# EAGLE board BalanduinoPCB-V1.1 (EAGLE 6.2)
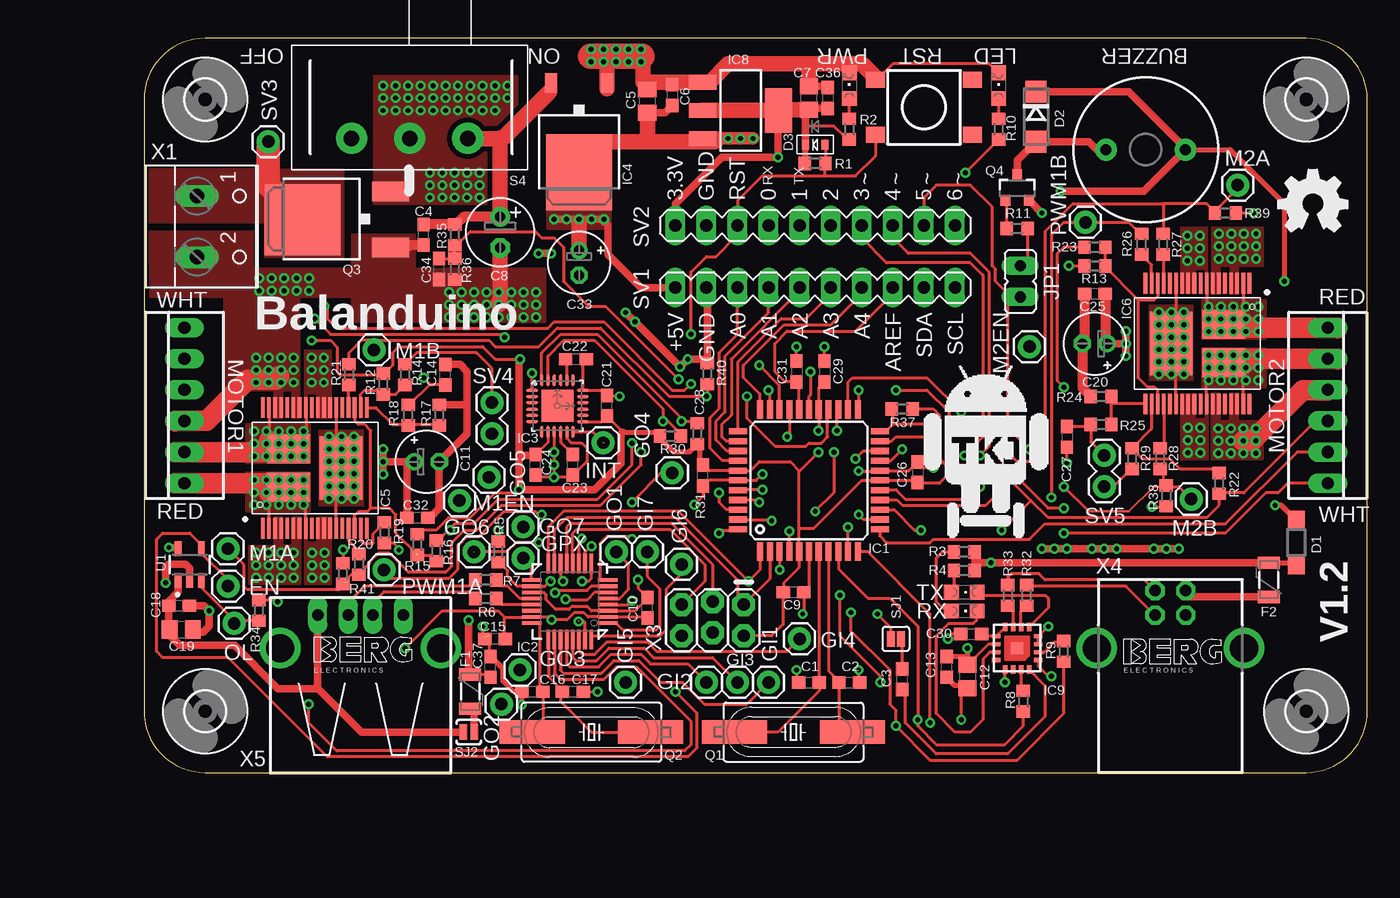
[diagram p2: board, top side]
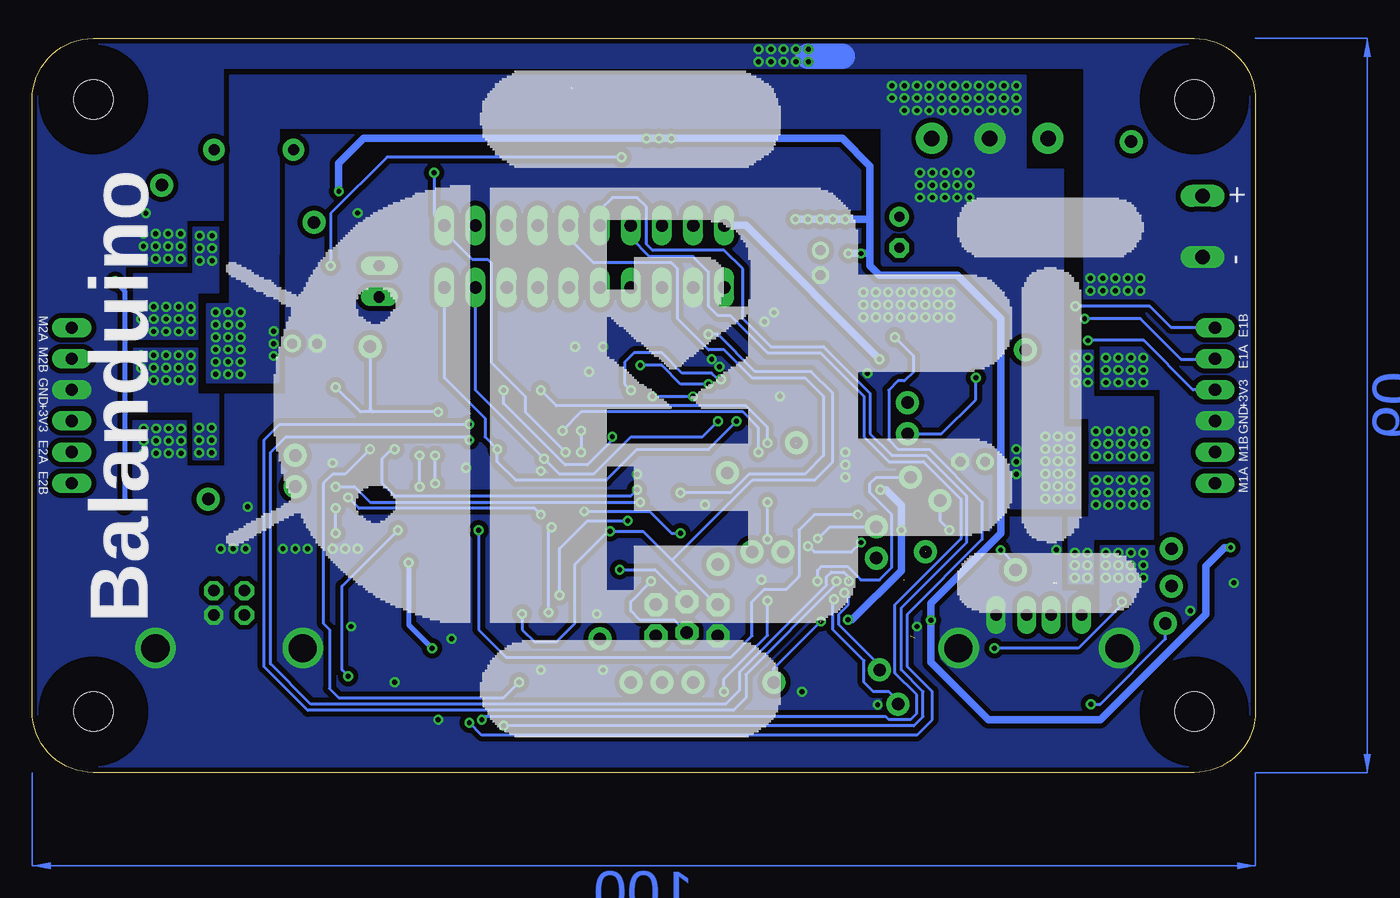
[diagram p3: board, bottom side, seen from below]

Size 100 x 60 mm. Coordinates in mm from the lower left corner, seen from the top.
Outline: 5,0 95,0 arc90 100,5 100,55 arc90 95,60 5,60 arc90 0,55 0,5 arc90 5,0
Copper layers (1*16): Top 0.035mm / dielectric 1.5mm / Bottom 0.035mm
Design rules "default": minimum track width 8mil, minimum drill 12mil, track to track 8mil, track to pad 8mil, pad to pad 7mil, via to via 8mil, smd to smd 0mil, copper to edge 8mil, drill to drill 8mil, minimum pad ring 12mil, minimum via ring 8mil, stop-mask expansion 4mil, vias tented up to drill 25mil, thermal gap 10mil

## Footprints (pad centres in the part's own frame; a part is rotated, then mirrored left to right if it is on the bottom)
BUZZER-12MM = drill 0.9 pad 1.778: + 3.25,0; - -3.25,0
C0603 = smd 1.1 x 1: 1 -0.85,0; 2 0.85,0
C0805 = smd 1.3 x 1.5: 1 -0.95,0; 2 0.95,0
E2,5-6 = drill 0.813 pad 1.6: + -1.27,0 | drill 0.813 pad 1.6 octagon: - 1.27,0
E2-5 = drill 0.813 pad 1.27: + -1.016,0 | drill 0.813 pad 1.27 octagon: - 1.016,0
SOD123 = smd 1.4 x 1.4: A 1.9,0; C -1.9,0
DO214AC = smd 1.8 x 1.7: A 2.05,0; C -2.05,0
SOD-523 = smd 0.8 x 0.6: A 0,-0.8; K 0,0.8
1X01 = drill 1.016 pad 1.88: 1 0,0
PTC-1206 = smd 1 x 1.8: 1 -1.4,0; 2 1.4,0
3,2 = hole 3.2: 0,0
TQFP44 = smd 1.5 x 0.5: 1 -5.8,4; 2 -5.8,3.2; 3 -5.8,2.4; 4 -5.8,1.6; 5 -5.8,0.8; 6 -5.8,0; 7 -5.8,-0.8; 8 -5.8,-1.6; 9 -5.8,-2.4; 10 -5.8,-3.2; 11 -5.8,-4; 23 5.8,-4; 24 5.8,-3.2; 25 5.8,-2.4; 26 5.8,-1.6; 27 5.8,-0.8; 28 5.8,0; 29 5.8,0.8; 30 5.8,1.6; 31 5.8,2.4; 32 5.8,3.2; 33 5.8,4 | smd 0.5 x 1.5: 12 -4,-5.8; 13 -3.2,-5.8; 14 -2.4,-5.8; 15 -1.6,-5.8; 16 -0.8,-5.8; 17 0,-5.8; 18 0.8,-5.8; 19 1.6,-5.8; 20 2.4,-5.8; 21 3.2,-5.8; 22 4,-5.8; 34 4,5.8; 35 3.2,5.8; 36 2.4,5.8; 37 1.6,5.8; 38 0.8,5.8; 39 0,5.8; 40 -0.8,5.8; 41 -1.6,5.8; 42 -2.4,5.8; 43 -3.2,5.8; 44 -4,5.8
TQFP32_8MIL = smd 0.294 x 1.6: 1 -1.75,-3.1; 2 -1.25,-3.1; 3 -0.75,-3.1; 4 -0.25,-3.1; 5 0.25,-3.1; 6 0.75,-3.1; 7 1.25,-3.1; 8 1.75,-3.1; 17 1.75,3.1; 18 1.25,3.1; 19 0.75,3.1; 20 0.25,3.1; 21 -0.25,3.1; 22 -0.75,3.1; 23 -1.25,3.1; 24 -1.75,3.1 | smd 1.6 x 0.294: 9 3.1,-1.75; 10 3.1,-1.25; 11 3.1,-0.75; 12 3.1,-0.25; 13 3.1,0.25; 14 3.1,0.75; 15 3.1,1.25; 16 3.1,1.75; 25 -3.1,1.75; 26 -3.1,1.25; 27 -3.1,0.75; 28 -3.1,0.25; 29 -3.1,-0.25; 30 -3.1,-0.75; 31 -3.1,-1.25; 32 -3.1,-1.75
TESTING_QFN-24-4MM2 = smd 1.016 x 0.254: 1 -2.066,1.257; 2 -2.066,0.75; 3 -2.066,0.247; 4 -2.066,-0.287; 5 -2.066,-0.792; 6 -2.066,-1.297; 13 2.086,-1.297; 14 2.086,-0.792; 15 2.086,-0.287; 16 2.086,0.247; 17 2.086,0.75; 18 2.086,1.257 | smd 0.254 x 1.016: 7 -1.267,-2.122; 8 -0.762,-2.122; 9 -0.258,-2.122; 10 0.278,-2.122; 11 0.78,-2.122; 12 1.287,-2.122; 19 1.287,2.082; 20 0.78,2.082; 21 0.278,2.082; 22 -0.258,2.082; 23 -0.762,2.082; 24 -1.267,2.082 | smd 2.616 x 2.616: P$1 0.02,-0.01
DPACK = smd 1 x 1.6: 1 -2.28,-4.8; 3 2.28,-4.8 | smd 5.4 x 6.2: 2 0,2.5
POWERSSO-36 = smd 1.7 x 0.3: 1 -4.933,4.25; 2 -4.933,3.75; 3 -4.933,3.25; 4 -4.933,2.75; 5 -4.933,2.25; 6 -4.933,1.75; 7 -4.933,1.25; 8 -4.933,0.75; 9 -4.933,0.25; 10 -4.933,-0.25; 11 -4.933,-0.75; 12 -4.933,-1.25; 13 -4.933,-1.75; 14 -4.933,-2.25; 15 -4.933,-2.75; 16 -4.933,-3.25; 17 -4.933,-3.75; 18 -4.933,-4.25; 19 4.933,-4.25; 20 4.933,-3.75; 21 4.933,-3.25; 22 4.933,-2.75; 23 4.933,-2.25; 24 4.933,-1.75; 25 4.933,-1.25; 26 4.933,-0.75; 27 4.933,-0.25; 28 4.933,0.25; 29 4.933,0.75; 30 4.933,1.25; 31 4.933,1.75; 32 4.933,2.25; 33 4.933,2.75; 34 4.933,3.25; 35 4.933,3.75; 36 4.933,4.25 | smd 5.2 x 3.5: S1 0,-2.15 | smd 2.35 x 3.5: S2 -1.575,2.15; S3 1.575,2.15
SOT223 = smd 1.219 x 2.235: 1 -2.311,-3.099; 2 0,-3.099; 3 2.311,-3.099 | smd 3.6 x 2.2: 4 0,3.099
QFN16 = smd 0.7 x 0.35: 1 -1.725,0.975; 2 -1.725,0.325; 3 -1.725,-0.325; 4 -1.725,-0.975; 9 1.725,-0.975; 10 1.725,-0.325; 11 1.725,0.325; 12 1.725,0.975 | smd 0.35 x 0.7: 5 -0.975,-1.725; 6 -0.325,-1.725; 7 0.325,-1.725; 8 0.975,-1.725; 13 0.975,1.725; 14 0.325,1.725; 15 -0.325,1.725; 16 -0.975,1.725 | smd 1 x 1: TAB 0,0
JP1 = drill 0.914 long: 1 0,-1.27; 2 0,1.27
CHIPLED_0805 = smd 1.2 x 1.2: A 0,-1.05; C 0,1.05
22-23-2061 = drill 1 long: 1 -6.35,0; 2 -3.81,0; 3 -1.27,0; 4 1.27,0; 5 3.81,0; 6 6.35,0
HC49UP = smd 5.334 x 1.93: 1 -4.826,0; 2 4.826,0
DPAK = smd 1.6 x 3: 1 -2.285,-7.18; 3 2.285,-7.18 | smd 5.8 x 6.2: 4 0,0
SOT23-3 = smd 0.8 x 0.9: 1 -0.95,-1; 2 0.95,-1; 3 0,1.1
R0603 = smd 1 x 1.1: 1 -0.85,0; 2 0.85,0
TACTILE_SWITCH_TALL = smd 1.55 x 1.3: A1 -3.975,-2.25; A2 3.975,-2.25; B1 -3.975,2.25; B2 3.975,2.25
SWITCH-SPDT = drill 1.27 pad 2.54: 1 -2.54,-4.623; 2 -2.54,0.127; 3 -2.54,4.877
SJ_2S = smd 0.635 x 1.27: 1 -0.412,0; 2 0.412,0
SJ_2S-NO = smd 0.635 x 1.27: 1 -0.45,0; 2 0.45,0
MA10-1 = drill 1.016 long: 1 -10.16,0; 2 -7.62,0; 3 -5.08,0; 4 -2.54,0; 5 0,0; 6 2.54,0; 7 5.08,0; 8 7.62,0; 9 10.16,0; 10 12.7,0
1X02 = drill 1.016 pad 1.88: 1 0,0; 2 2.54,0
SOT23-5 = smd 0.55 x 1.2: 1 -0.95,-1.3; 2 0,-1.3; 3 0.95,-1.3; 4 0.95,1.3; 5 -0.95,1.3
W237-102 = drill 1.194 long: 1 -2.5,-1.27; 2 2.5,-1.27
2X3_LOCK = drill 1.016 pad 1.88 octagon: 1 0,0; 2 0,2.54; 3 2.54,-0.254; 4 2.54,2.286; 5 5.08,0; 6 5.08,2.54
PN61729-S = drill 0.95 octagon: 1 1.25,4.71; 2 -1.25,4.71; 3 -1.25,2.71; 4 1.25,2.71 | drill 2.3 pad 2.9: S1 -6.02,0; S2 6.02,0
PN87520-S = drill 0.95 long: 1 -3.5,2.71; 2 -1,2.71; 3 1,2.71; 4 3.5,2.71 | drill 2.3 pad 2.9: S1 -6.57,0; S2 6.57,0

## Placement (x,y rotation side)
BUZZER  BUZZERPTH-W/OSCILLATOR (WST-1205S)  [BUZZER-12MM]  81.89,50.9 0 top
C1  18pF  [C0603]  54.36,7.37 0 top
C2  18pF  [C0603]  57.66,7.37 0 top
C3  100nF  [C0603]  61.98,7.62 90 top
C4  100nF/16V  [C0603]  22.86,43.94 90 top
C5  10uF  [C0805]  41.15,54.86 90 top
C6  100nF  [C0603]  43.18,55.37 270 top
C7  10uF  [C0805]  54.36,55.12 90 top
C8  100uF/16V  [E2,5-6]  29.11,44.15 270 top
C9  100nF  [C0603]  53.09,14.73 180 top
C10  100nF  [C0603]  41.15,13.46 90 top
C11  47uF/16V  [E2-5]  23.11,25.4 0 top
C12  4.7uF  [C0805]  67.31,7.85 270 top
C13  100nF  [C0603]  65.61,8.64 90 top
C14  33nF  [C0603]  24.64,32.51 90 top
C15  100nF  [C0603]  28.7,10.92 180 top
C16  18pF  [C0603]  31.75,6.6 0 top
C17  18pF  [C0603]  35.05,6.6 180 top
C18  100nF  [C0603]  2.87,13.64 0 top
C19  4.7uF  [C0805]  3.05,11.68 0 top
C20  47uF/16V  [E2-5]  77.72,35.05 180 top
C21  100nF  [C0603]  37.85,29.97 90 top
C22  2.2nF  [C0603]  35.31,33.78 0 top
C23  100nF  [C0603]  35.05,25.15 90 top
C24  10nF  [C0603]  32,25.15 90 top
C25  100nF  [C0603]  77.72,39.12 180 top
C26  100nF  [C0603]  63.22,24.54 270 top
C27  33nF  [C0603]  75.44,27.43 270 top
C28  100nF  [C0603]  45.69,24.28 90 top
C29  100nF  [C0603]  55.63,32.77 270 top
C30  100nF  [C0603]  67.61,11.33 0 top
C31  100nF  [C0603]  53.34,32.77 270 top
C32  100nF  [C0603]  22.35,20.83 0 top
C33  47uF/16V  [E2-5]  35.56,41.66 270 top
C34  100nF  [C0603]  24.13,41.15 90 top
C36  100nF  [C0603]  55.88,55.12 270 top
C37  100nF  [C0603]  28.32,8.64 90 top
D1  MBR0520  [SOD123]  94.18,18.8 270 top
D2  S1M-13-F  [DO214AC]  72.9,53.59 270 top
D3  1N4148  [SOD-523]  54.86,51.31 90 top
EN  Enable  [1X01]  6.86,15.24 0 top
F1  PTC_500mA  [PTC-1206]  26.67,6.6 270 top
F2  PTC_500mA  [PTC-1206]  91.95,15.75 90 top
GI1  M01PTH  [1X01]  51.05,7.37 90 top
GI2  M01PTH  [1X01]  45.97,7.37 90 top
GI3  M01PTH  [1X01]  48.51,7.37 90 top
GI4  M01PTH  [1X01]  53.59,10.92 90 top
GI5  M01PTH  [1X01]  39.37,7.37 90 top
GI6  M01PTH  [1X01]  43.94,17.02 90 top
GI7  M01PTH  [1X01]  41.15,18.03 90 top
GO1  M01PTH  [1X01]  38.61,18.03 90 top
GO2  M01PTH  [1X01]  29.21,5.59 90 top
GO3  M01PTH  [1X01]  30.73,8.38 90 top
GO4  M01PTH  [1X01]  43.18,24.49 90 top
GO5  M01PTH  [1X01]  28.19,24.13 90 top
GO6  M01PTH  [1X01]  26.97,18.03 90 top
GO7  M01PTH  [1X01]  30.99,20.07 90 top
GPX  M01PTH  [1X01]  30.99,17.53 0 top
H1  MOUNT-HOLE3.2  [3,2]  5,5 0 top
H2  MOUNT-HOLE3.2  [3,2]  95,5 0 top
H3  MOUNT-HOLE3.2  [3,2]  5,55 0 top
H4  MOUNT-HOLE3.2  [3,2]  95,55 0 top
IC1  ATMEGA1284PA  [TQFP44]  54.36,23.88 90 top
IC2  MAX3421E  [TQFP32_8MIL]  34.8,13.97 90 top
IC3  MPU-6050  [TESTING_QFN-24-4MM2]  33.78,29.97 0 top
IC4  MC33269D-5.0  [DPACK]  35.56,51.56 180 top
IC5  VNH5180ATR-E  [POWERSSO-36]  13.97,24.89 90 top
IC6  VNH5180ATR-E  [POWERSSO-36]  86.11,35.05 270 top
IC8  LD1117-3V3  [SOT223]  48.77,54.1 270 top
IC9  FT230XQ  [QFN16]  71.37,10.16 180 top
INT  M01PTH  [1X01]  37.54,26.95 0 top
JP1  [JP1]  71.63,40.13 0 top
LED  Yellow  [CHIPLED_0805]  69.85,56.13 0 top
LOGO2  OSHW_LOGO_FILLX0200-NT  [OSHW_FILLX200_NOTEXT]  92.71,44.2 0 top
M1A  M01PTH  [1X01]  6.86,18.29 0 top
M1B  M01PTH  [1X01]  18.8,34.54 0 top
M1EN  M01PTH  [1X01]  25.78,22.23 0 top
M2A  M01PTH  [1X01]  89.41,48.01 0 top
M2B  M01PTH  [1X01]  85.6,22.35 270 top
M2EN  M01PTH  [1X01]  72.39,34.8 0 top
MOTOR1  1744037-6(SEE-PICTURE)  [22-23-2061]  3.3,30 90 top
MOTOR2  1744037-6(SEE-PICTURE)  [22-23-2061]  96.77,30 270 top
OL  Overload  [1X01]  7.37,12.19 0 top
PWM1A  M01PTH  [1X01]  19.61,16.56 0 top
PWM1B  M01PTH  [1X01]  76.96,44.96 0 top
PWR  Green  [CHIPLED_0805]  57.66,56.13 0 top
Q1  10MHz  [HC49UP]  53.09,3.3 180 top
Q2  12MHz  [HC49UP]  36.58,3.3 0 top
Q3  DMP3025  [DPAK]  12.98,45.19 90 top
Q4  [SOT23-3]  71.37,47.75 0 top
R1  10K  [R0603]  54.86,49.78 180 top
R2  1K  [R0603]  57.66,52.58 270 top
R3  1K  [R0603]  67.06,18.03 0 top
R4  1K  [R0603]  67.06,16.51 0 top
R5  2.2K  [R0603]  28.96,18.03 90 top
R6  33/1%  [R0603]  27.94,14.22 0 top
R7  33/1%  [R0603]  27.94,15.75 0 top
R8  1K  [R0603]  71.88,5.84 90 top
R9  1K  [R0603]  75.18,9.91 90 top
R10  1K  [R0603]  69.85,52.58 270 top
R11  1K  [R0603]  71.37,44.45 180 top
R12  10K  [R0603]  19.56,31.75 90 top
R13  10K  [R0603]  77.72,41.4 180 top
R14  1K  [R0603]  21.34,32.51 270 top
R15  10K  [R0603]  22.35,18.62 90 top
R16  1K  [R0603]  23.9,18.11 90 top
R17  1K5  [R0603]  24.13,29.21 270 top
R18  10K  [R0603]  21.59,29.21 270 top
R19  1K  [R0603]  19.66,19.61 270 top
R20  1K  [R0603]  17.58,17.02 270 top
R21  1K  [R0603]  16.76,32.51 90 top
R22  10K  [R0603]  87.88,23.62 270 top
R23  1K  [R0603]  77.72,42.93 180 top
R24  1K5  [R0603]  78.23,30.73 0 top
R25  10K  [R0603]  78.23,28.45 0 top
R26  1K  [R0603]  81.53,43.18 90 top
R27  1K  [R0603]  83.31,43.18 90 top
R28  1K  [R0603]  83.06,25.65 270 top
R29  1K  [R0603]  80.77,25.65 90 top
R30  10K  [R0603]  43.03,27.48 180 top
R31  10K  [R0603]  45.21,27.69 270 top
R32  27  [R0603]  72.14,14.48 270 top
R33  27  [R0603]  70.61,14.48 270 top
R34  10K  [R0603]  9.4,13.26 90 top
R35  47K  [R0603]  25.4,43.94 90 top
R36  12K  [R0603]  25.4,41.15 90 top
R37  10K  [R0603]  61.98,29.72 180 top
R38  10K  [R0603]  83.57,22.61 90 top
R39  10K  [R0603]  88.39,45.72 180 top
R40  10K  [R0603]  46.05,32.59 270 top
R41  10K  [R0603]  16.26,16.26 270 top
RX  YELLOW  [CHIPLED_0805]  67.06,13.21 270 top
S1  DTSM-62K-S-V-T/R(SN431)  [TACTILE_SWITCH_TALL]  63.75,54.36 180 top
S2  BALANDUINO-SMALL  [BALANDUINO-SMALL]  68.83,26.42 0 top
S3  BALANDUINO-LARGE  [BALANDUINO-LARGE]  45.97,29.21 90 bottom
S4  [SWITCH-SPDT]  21.84,54.36 90 top
SJ1  SOLDERJUMPERNC  [SJ_2S]  61.47,10.92 180 top
SJ2  SOLDERJUMPERNO  [SJ_2S-NO]  26.54,3.3 0 top
SV1  [MA10-1]  53.59,39.62 0 top
SV2  [MA10-1]  53.59,44.7 0 top
SV3  M01PTH  [1X01]  10.16,51.56 0 top
SV4  [1X02]  28.45,27.69 90 top
SV5  [1X02]  78.49,25.91 270 top
TX  YELLOW  [CHIPLED_0805]  67.06,14.73 270 top
U1  NCP380HSN05AAT1G  [SOT23-5]  3.73,16.99 0 top
X1  [W237-102]  5.59,44.62 270 top
X3  AVR_SPI_PRG_62X3_LOCK  [2X3_LOCK]  49.02,13.72 180 top
X4  PN61729-S  [PN61729-S]  83.9,10.16 0 top
X5  PN87520-S  [PN87520-S]  17.7,10.16 0 top

## Tracks (layer width: path | path; a pad name or v marks a point on that pad's centre or on a via)
+3V3  (via drill 0.4)
  Top 0.254: 52.25,14.73 52.27,14.76 52.27,15.47 53.56,16.75 IC1.5 53.56,19.95 | 52.25,14.73 52.32,14.73 52.32,14.99 | 52.25,14.73 C9.2 52.24,12.1 51.31,11.18 X3.2 | C29.2 55.16,31.45 IC1.27 55.16,27.98 v55.12,27.94 | C28.2 46.15,24.68 IC1.38 49.57,24.68 50.29,25.4 52.83,25.4 53.56,24.68 | IC3.13 37.4,28.68 C21.1 39.12,27.85 39.12,27.81 | IC3.8 33.02,27 32.03,26.01 32.03,25.93 32,25.91 C24.2 | v13.72,35.31 15.24,35.31 15.8,34.75 15.8,32.71 16,32.51 19.47,32.51 R12.2 19.65,32.6 | MOTOR2.4 95.79,28.73 89.92,22.86 87.88,22.86 R22.2 87.88,21.84 86.87,20.83 73.91,20.83 72.52,22.22 | IC2.23 | 53.56,19.95 53.56,24.65 | 53.56,24.65 53.58,24.65 | 53.58,24.65 53.59,24.64 v55.12,26.16 | 53.56,24.65 53.56,24.68 | v75.59,41.4 R13.2 | 72.52,22.22 70.1,24.64 66.04,24.64 | 66.04,24.64 65.02,23.62 63.16,23.62 | 53.56,19.95 54.75,19.95 58.67,23.88 IC1.17 63.03,23.88 C26.2 63.16,23.62 | 30.66,33.78 28.7,33.78 27.69,34.8 20.83,34.8 20.32,34.29 20.32,33.27 19.65,32.6 | 30.66,33.78 30.66,33.71 30.65,33.7 | R2.2 57.24,51.73 57.24,51.98 56.39,52.83 54.01,52.83 | 53.56,24.68 53.58,24.65 | IC9.1 73.1,8.69 73.91,7.87 v74.17,7.87 | v70.1,19.81 72.52,22.22 | R37.1 64.52,29.72 65.02,29.21 65.02,25.65 66.04,24.64 | C10.1 41.04,12.72 IC2.2 36.3,12.72 35.94,13.08 35.18,13.08 34.57,12.47 v33.3,12.47 33.05,12.72 IC2.23 | R5.2 v28.96,19.81 | 42.43,27.45 42.42,27.43 | v21.34,10.16 24.38,13.21 28.96,13.21 29.46,12.7 | 29.46,12.7 31.5,12.7 31.52,12.72 IC2.23 | 29.46,12.7 29.46,11.34 29.55,11.25 C15.1 | 62.9,23.62 63.16,23.62 | v30.73,33.78 30.66,33.78 | 19.65,32.6 19.56,32.51 | R34.2 10.78,14.11 v10.92,13.97 | R15.2 22.34,19.47 22.3,19.51 22.61,19.81 23.88,19.81 24.89,20.83 26.67,20.83 28.7,22.86 30.48,22.86 30.73,23.11
  Top 0.406: 45.54,24.84 45.64,24.94 45.64,25.07 C28.2 | C28.2 45.47,25.36 45.47,26.58 R31.2 44.59,26.21 43.28,26.21 42.18,27.32 R30.2 | C28.2 45.72,25.15 | 39.12,27.81 42.16,27.81 42.18,27.8 R30.2 | R30.2 42.37,27.48 42.42,27.43
  Top 0.508: D3.K 54.03,51.31 54.03,50.29 54.01,50.29 R1.2 | 54.01,52.83 54.06,52.83 54.06,53.59 | IC8.4 52.07,54.1 52.07,54.36
  Top 0.61: 51.82,54.15 v51.82,50.29 47.24,50.29 43.43,46.48 SV2.1 | 30.65,25.91 v30.65,23.12 v30.66,23.11 | v30.66,23.11 30.73,23.11 36.83,23.11 38.99,25.27 38.99,27.69 39.12,27.81 | 32,25.91 30.65,25.91 | v30.66,23.11 30.66,23.04 | 30.65,25.91 30.65,33.7 | C36.2 54.46,54.27 C7.1 | C7.1 54.36,54.36 54.01,54.01 54.06,54.01 54.06,53.59 D3.K | C7.1 54.36,54.1 | 52.26,54.17 52.07,54.36
  Top 1.27: IC8.2 IC8.4 51.82,54.15 | 51.82,54.15 | C7.1 52.26,54.17
  Bottom 0.254: MOTOR1.4 5.11,31.27 9.14,35.31 v13.72,35.31 | v55.12,27.94 v55.12,26.16 | v51.82,50.29 70.99,50.29 75.59,45.69 v75.59,41.4 | v74.17,7.87 74.68,8.38 74.68,15.24 v70.1,19.81 | v10.92,13.97 10.92,13.72 14.48,10.16 v21.34,10.16
  Bottom 0.61: v30.73,33.78 41.66,44.7 SV2.1 | v30.66,23.11 30.23,23.11 28.96,21.84 v28.96,19.81 28.96,16.51 32.99,12.47 v33.3,12.47
+5V  (via drill 0.4)
  Top 0.254: 2.69,18.39 U1.5 | U1.5 | U1.5 | 28.19,8.04 26.71,8.04 F1.1 | 28.19,8.04 28.28,8.04 28.45,7.87 | C37.1 28.32,7.91 28.19,8.04 | F1.1 26.67,8.13 | 26.54,8.13 26.55,8.13 F1.1
  Top 0.406: v93.22,40.13 93.22,46.48 88.8,50.9 BUZZER.+ | 46.63,51.54 46,51.54 45.72,51.82 | IC8.3 45.24,51.79 45.21,51.82 | 37.95,44.65 37.95,44.86 v37.59,45.21 | D1.C 94.11,20.7 92.96,21.84 v92.46,21.84
  Top 0.61: v33.27,42.42 v32.26,42.42 | C5.1 42.57,53.91 C6.2 | v33.53,45.21 v34.54,45.21 v35.56,45.21 v36.58,45.21 v37.59,45.21 37.59,44.98 | v26.54,12.45 26.54,8.13 | v2.03,18.39 2.69,18.39 | SV1.1 40.64,39.62 37.95,42.32 37.95,44.65 | D2.C 80.5,55.64 85.22,50.93 85.16,50.93 BUZZER.+ 81.74,47.5 v74.93,47.5
  Top 1.016: v49.78,51.82 45.72,51.82 45.21,51.82 44.96,51.82
  Top 1.27: 35.31,51.03 35.74,51.46 35.61,51.46 35.53,51.54 40.89,51.54 | 40.89,51.54 46.63,51.54 46.86,51.76 | C5.1 41.15,51.79 40.89,51.54 | C33.+ 35.56,44.96
  Bottom 0.406: v93.22,40.13 92.46,39.37 v92.46,21.84
  Bottom 0.61: v74.93,47.5 74.93,49.78 72.9,51.82 v49.78,51.82 v48.77,51.82 v47.75,51.82 33.78,51.82 31.5,49.53 31.5,45.21 | 31.5,42.42 31.5,41.4 30.73,40.64 24.38,40.64 20.83,37.08 20.83,19.56 26.54,13.84 v26.54,12.45 26.54,9.02 21.84,4.32 12.7,4.32 4.06,12.95 4.06,16.86 2.54,18.39 v2.04,18.39 v2.03,18.39 | 31.5,42.42 31.5,45.21 | 31.5,42.42 v32.26,42.42 v33.27,42.42 | v37.59,45.21 31.5,45.21
  pour Top (no thermals): 32.97,46.74 38.15,46.74 38.15,44.45 32.97,44.45
A0
  Top 0.254: SV1.3 48.51,35.81 46.99,34.29 46.99,29.72 46.23,28.96 46.23,26.54 47.24,25.53 48.51,25.53 IC1.37
A1
  Top 0.254: IC1.36 48.54,26.26 47.65,26.26 46.74,27.18 46.74,28.7 47.5,29.46 47.5,34.04 51.05,37.59 SV1.4
A2
  Top 0.254: SV1.5 53.59,39.37 48.01,33.78 48.01,29.21 47.24,28.45 47.24,27.43 47.6,27.08 IC1.35
A3
  Top 0.254: IC1.34 48.56,27.9 48.51,27.94 48.51,33.53 52.07,37.08 54.1,37.08 56.13,39.12 SV1.6
A4
  Top 0.254: IC1.33 50.36,30.92 49.02,32.26 49.02,33.27 52.32,36.58 56.13,36.58 58.67,39.12 SV1.7
AREF
  Top 0.254: IC1.29 53.56,31.7 C31.2 52.41,31.92 51.56,32.77 51.56,35.05 52.58,36.07 58.17,36.07 61.21,39.12 SV1.8
BUZZER  (via drill 0.4)
  Top 0.254: 71.37,38.86 70.87,38.86 69.6,40.13 69.6,41.15 69.34,41.4 69.34,46.23 67.56,48.01 64.77,48.01 63.75,46.99 SV2.9 | v60.2,7.37 60.2,7.87 56.9,11.18 v56.9,14.48 | IC1.43 51.21,20.68 v51.31,20.57 | v72.39,26.42 70.61,28.19 70.61,38.1 71.37,38.86 | 71.37,38.86 JP1.1
  Bottom 0.254: v72.39,26.42 74.42,24.38 75.44,24.38 76.2,23.62 76.2,12.19 75.69,11.68 75.69,6.86 74.93,6.1 61.47,6.1 v60.2,7.37 | v56.9,14.48 56.9,18.29 54.61,20.57 v51.31,20.57
EN1A  (via drill 0.4)
  Top 0.254: v29.46,35.56 29.21,35.81 15.24,35.81 v13.97,37.08 | IC1.11 58.38,18.08 58.42,18.03 59.18,18.03 64.26,12.95 v64.26,4.06
  Bottom 0.254: v13.97,37.08 9.4,37.08 6.1,33.78 3.3,33.78 MOTOR1.5 | v64.26,4.06 63.25,3.05 27.69,3.05 26.42,4.32 26.42,6.6 28.45,8.64 28.45,12.95 22.35,19.05 22.35,22.1 26.67,26.42 29.21,26.42 29.97,27.18 29.97,31.24 29.21,32 28.7,32 27.94,32.77 27.94,34.04 v29.46,35.56
EN1B  (via drill 0.4)
  Top 0.254: v14.73,38.1 14.99,37.85 14.99,37.08 15.75,36.32 33.02,36.32 33.53,36.83 37.59,36.83 43.18,31.24 44.2,31.24 v44.7,31.75 | IC1.31 51.92,29.71 51.92,31.65 v50.29,33.27
  Bottom 0.254: MOTOR1.6 6.89,36.35 8.64,38.1 v14.73,38.1 | v44.7,31.75 46.99,31.75 48.51,33.27 v50.29,33.27
EN2A
  Top 0.254: MOTOR2.5 94.26,26.19 88.39,20.32 73.66,20.32 72.39,19.05 64.52,19.05 64.26,18.8 60.71,18.8 60.16,19.35 IC1.12
EN2B  (via drill 0.4)
  Top 0.254: MOTOR2.6 93.5,23.65 92.71,22.86 91.69,22.86 88.39,19.56 v75.18,19.56 | IC1.30 52.76,27.61 v52.58,27.43 | v61.47,31.24 64.01,31.24 65.79,29.46 65.79,25.91 66.55,25.15 70.36,25.15 73.91,21.59 v75.18,21.59
  Bottom 0.254: v52.58,27.43 52.58,27.18 54.61,25.15 56.44,25.15 61.47,30.17 v61.47,31.24 | v75.18,19.56 v75.18,21.59
GND  (via drill 0.4)  (2 unrouted)
  Top 0.203: v82.4,21.72 83.53,21.72 R38.1
  Top 0.254: IC2.19 32.65,14.72 32.87,14.5 32.87,14.12 33.66,13.33 34.75,13.33 35,13.59 36.19,13.59 36.56,13.22 IC2.3 40.14,13.22 41.15,14.22 C10.2 | IC1.6 54.36,15.15 C9.1 53.94,13.04 v53.85,12.95 | v75.44,25.3 C27.2 | IC3.9 33.52,24.3 33.53,24.3 v33.53,24.13 | v33.53,24.13 32,24.13 C24.1 32,24.38 | v33.53,24.13 34.8,24.13 35.05,24.38 C23.1 36.19,25.44 36.19,26.52 35.76,26.95 34.93,26.95 34.56,27.31 IC3.11 | C31.1 v53.34,34.8 | C29.1 v55.63,34.8 | v58.42,24.64 59.94,24.64 59.98,24.68 IC1.18 62.52,24.68 C26.1 63.72,24.89 v64.52,24.89 | IC3.1 31.72,32.55 v31.72,32.64 | 45.72,23.37 45.69,23.39 C28.1 45.69,22.58 v45.01,21.89 | LED.C 69.82,57.18 69.09,57.91 61.21,57.91 59.94,56.64 59.81,56.64 S1.A2 | Q4.2 72.37,46.75 | v50.55,24.38 50.04,23.88 IC1.39 45.97,23.88 45.72,23.62 | v27.69,11.94 27.69,11.18 | 27.69,11.18 27.43,11.18 | IC9.3 IC9.4 73.11,11.13 v73.91,11.94 | C13.1 65.87,7.79 | C30.1 66.12,11.33 v65.71,10.92 | v66.8,4.32 66.8,6.39 C12.2 67.1,7.11 66.67,7.11 | v70.36,7.37 70.36,8.38 70.4,8.42 IC9.13 | Q3.1 21.49,42.9 | v90.7,45.69 89.27,45.69 R39.1 | v16.28,18.21 16.28,17.25 16.38,17.14 | 16.38,17.14 16.51,17.02 | 36.5,58.55 36.5,58.14 v36.55,58.09 | v40.61,58.09 40.56,58.09 40.51,58.04 | 28.19,11.18 28.19,9.99 28.32,9.87 C37.2 | C10.2 41.15,14.48 | C17.1 v37.08,6.6 | v40.39,15.75 40.39,15.07 C10.2 | IC1.28 54.36,30.73 54.48,30.86 v54.48,32.77 | v53.34,8.38 53.34,7.62 53.59,7.37 C1.1 53.34,7.37 | v58.42,8.38 58.42,7.45 C2.2 | C15.2 27.85,11.01 27.69,11.18 | v38.86,30.73 37.93,30.73 C21.2 37.44,31.23 IC3.18 35.87,33.75 35.9,33.78 C22.2 | R41.1 16.34,17.11 16.38,17.14
  Top 0.406: 43.14,56.26 C6.1 42.99,56.41 41.15,56.41 | 66.67,7.11 66.28,7.11 C13.1 | C37.2 29.34,8.47 29.34,7.49 30.23,6.6 C16.1 30.99,6.6 30.89,6.5 v30.89,5.54
  Top 0.61: R17.1 24.14,30.07 26.31,30.07 26.42,29.97 | C14.2 25.82,33.36 26.42,32.77 26.42,29.97 | 26.42,29.97 26.42,27.69 C11.- 24.13,21.59 23.37,20.83 C32.2 | 82.8,18.29 v82.55,18.29 | v82.55,18.29 v79.5,18.29 | v79.5,18.29 v78.49,18.29 v77.47,18.29 | v82.55,18.29 v84.58,18.29 | v39.37,37.59 v40.13,36.83 v43.81,33.15 v44.45,33.78 46.05,33.78 R40.1 46.05,39.62 SV1.2 | 72.37,46.75 v73.41,45.72 | v79.5,18.29 v75.44,18.29 v74.42,18.29 v73.41,18.29 | U1.2 3.73,16.69 3.4,17.02 2.03,17.02 1.78,16.76 v1.78,15.49 | 3.77,11.45 4.85,11.45 5.33,11.94 v5.33,13.21 4.9,13.64 C18.2 | C7.2 55.69,56.07 55.88,55.88 | PWR.C 57.66,57.91 | 3.72,11.45 3.77,11.45 | 3.77,11.45 C19.2